# EasyEDA Pro project URADORRY-SUN1.2.eprj, board Main(1.2)
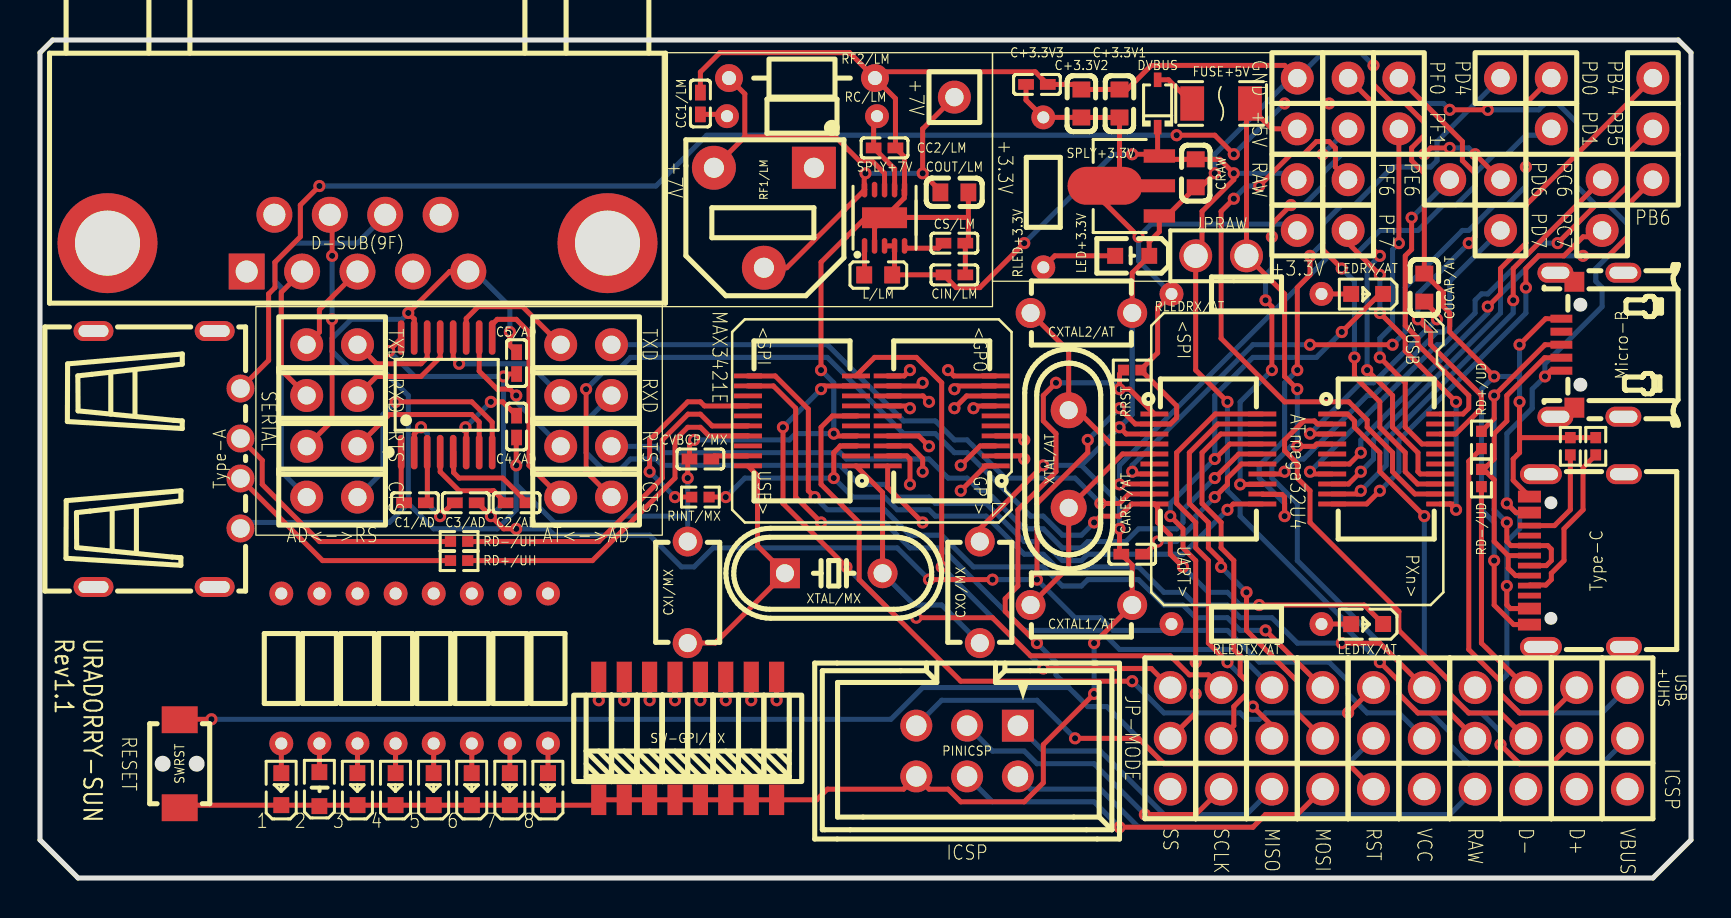
[diagram p11: board, top side]
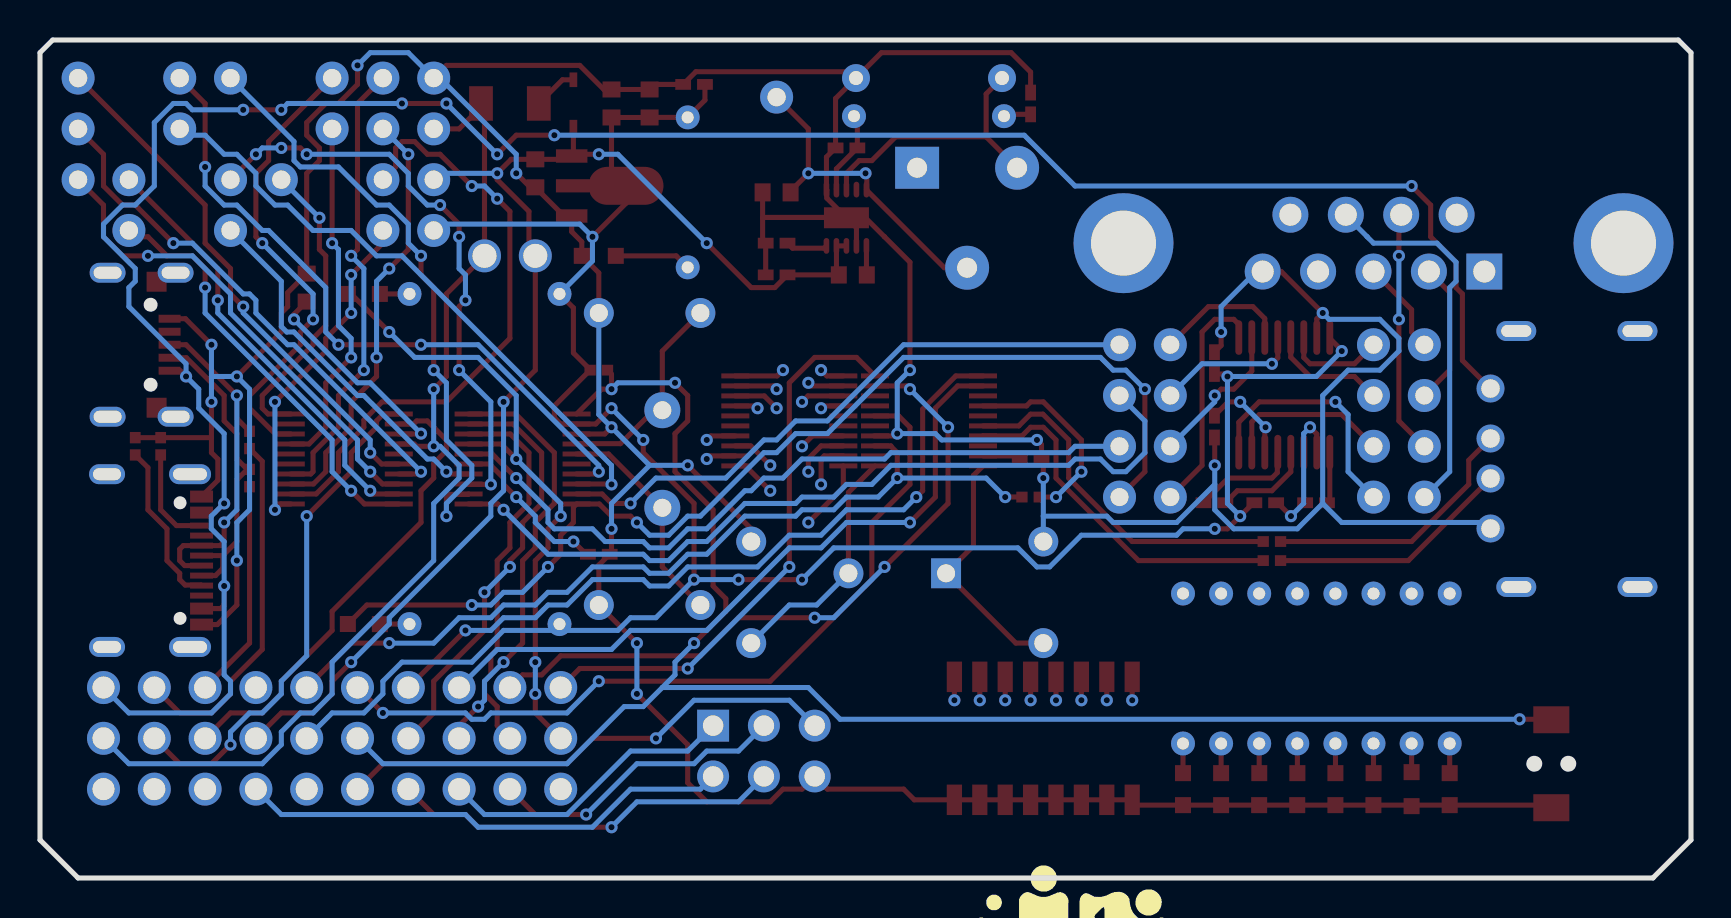
[diagram p12: board, bottom side, seen from below]

Outline 82.55 x 41.91 mm; copper layers: Top Layer, Inner1, Inner2, Bottom Layer. Coordinates in mm from the lower left corner of the outline.
Outline path: 0,41.28 0.64,41.91 81.91,41.91 82.55,41.28 82.55,1.91 80.65,0 1.91,0 0,1.91 0,41.28
Stack: Top Layer 0.035mm 外层铜厚1oz / Dielectric1 0.2104mm 7628 RC49% 8.6mil / Inner1 0.0152mm 内层铜厚 / Dielectric2 1.065mm 1.1mm H/HOZ 含铜 / Inner2 0.0152mm 内层铜厚 / Dielectric3 0.2104mm 7628 RC49% 8.6mil / Bottom Layer 0.035mm 外层铜厚1oz

## Design rules (mm)
template: JLCPCB Capability(Two Layers Board)
spacing copperThickness1oz (default): track to track 0.102, other pairs 0.152 to 0.3
spacing copperThickness2oz: track to track 0.203, other pairs 0.152 to 0.3
track width copperThickness1oz (default): min 0.127, default 0.254, max 2.54
track width copperThickness2oz: min 0.203, default 0.254, max 2.54
differential pair differentialPair (default): width min 0.127, default 0.254, max 2.54; gap min 0.152, default 0.152
via viaSize (default): diameter min 0.5, default 0.61, max 10; hole min 0.3, default 0.305, max 6.3

## Placement (name value [footprint] x y rotation side)
C1/AD  100nF  [C0402]  18.75 18.77 180 top
C2/AD  100nF  [C0402]  23.83 18.77 180 top
C3/AD  100nF  [C0402]  21.29 18.77 180 top
C4/AD  100nF  [C0402]  23.83 22.58 90 top
C5/AD  100nF  [C0402]  23.83 25.75 90 top
C+3.3V1  10uF  [C0603]  53.97 38.74 90 top
C+3.3V2  1uF  [C0603]  52.07 38.74 90 top
C+3.3V3  100nF  [C0402]  49.85 39.69 0 top
CAREF/AT  100nF  [C0402]  54.61 16.19 0 top
CC1/LM  2.2nF  [C0402]  33.02 38.74 90 top
CC2/LM  15pF  [C0402]  42.23 36.51 0 top
CIN/LM  4.7uF  [C0402]  45.72 30.16 0 top
COUT/LM  10uF  [C0603]  45.72 34.29 0 top
CRAW  10uF  [C0603]  57.78 35.24 270 top
CS/LM  10nF  [C0402]  45.72 31.75 180 top
CUCAP/AT  1uF  [C0603]  69.22 29.53 270 top
CVBCP/MX  100nF  [C0402]  33.02 20.96 0 top
CXI/MX  20pF  [CAP-TH_L5.0-W3.2-P5.08-D0.6]  32.39 14.29 270 top
CXO/MX  20pF  [CAP-TH_L5.0-W3.2-P5.08-D0.6]  46.99 14.29 270 top
CXTAL1/AT  20pF  [CAP-TH_L5.0-W3.2-P5.08-D0.6]  52.07 13.65 180 top
CXTAL2/AT  20pF  [CAP-TH_L5.0-W3.2-P5.08-D0.6]  52.07 28.26 180 top
D-SUB(9F)  D-SUB-DR-9PCM-CB  [DB9-TH_ID09S33E4GV00LF]  15.88 31.75 180 top
DVBUS  CUS08F30,H3F  [SOD-323F_L2.0-W1.6-LS2.5-RD]  55.88 38.74 90 top
FUSE+5V  BSMD1206-050-16V  [F1206]  59.06 38.74 180 top
JP+3.3V  PZ254V-11-03P  [hdr-th_3p-p2.54-v-m]  69.22 6.99 90 top
JP+5V  PZ254V-11-03P  [hdr-th_3p-p2.54-v-m]  79.38 6.99 90 top
JPCTS-AT  MF254V-11-02-0743  [hdr-th_2p-p2.54-v-f-2]  27.31 19.05 180 top
JPCTS-RS  MF254V-11-02-0743  [hdr-th_2p-p2.54-v-f-2]  14.61 19.05 180 top
JPD+  PZ254V-11-03P  [hdr-th_3p-p2.54-v-m]  76.84 6.99 90 top
JPD-  PZ254V-11-03P  [hdr-th_3p-p2.54-v-m]  74.3 6.99 90 top
JPMISO  PZ254V-11-03P  [hdr-th_3p-p2.54-v-m]  61.59 6.99 90 top
JPMOSI  PZ254V-11-03P  [hdr-th_3p-p2.54-v-m]  64.14 6.99 90 top
JPRAW  PZ254V-11-02P  [hdr-th_2p-p2.54-v-m]  59.06 31.12 180 top
JPRAW2  PZ254V-11-03P  [hdr-th_3p-p2.54-v-m]  71.75 6.99 90 top
JPRST  PZ254V-11-03P  [hdr-th_3p-p2.54-v-m]  66.68 6.99 90 top
JPRTS-AT  MF254V-11-02-0743  [hdr-th_2p-p2.54-v-f-2]  27.31 21.59 180 top
JPRTS-RS  MF254V-11-02-0743  [hdr-th_2p-p2.54-v-f-2]  14.61 21.59 180 top
JPRXD-AT  MF254V-11-02-0743  [hdr-th_2p-p2.54-v-f-2]  27.31 24.13 180 top
JPRXD-RS  MF254V-11-02-0743  [hdr-th_2p-p2.54-v-f-2]  14.61 24.13 180 top
JPSCLK  PZ254V-11-03P  [hdr-th_3p-p2.54-v-m]  59.06 6.99 90 top
JPSS  PZ254V-11-03P  [hdr-th_3p-p2.54-v-m]  56.52 6.99 90 top
JPTXD-AT  MF254V-11-02-0743  [hdr-th_2p-p2.54-v-f-2]  27.31 26.67 180 top
JPTXD-RS  MF254V-11-02-0743  [hdr-th_2p-p2.54-v-f-2]  14.61 26.67 180 top
L/LM  4.7uH  [L0603]  41.91 30.16 180 top
LED+3.3V  XL-TD1608SURC  [LED0603-R-RD_RED]  54.61 31.12 180 top
LEDGPO0  19-217UYOC/S3112/TR8  [LED0603-RD]  12.07 4.45 90 top
LEDGPO1  XL-1608UBC-06A  [LED0603-R-RD]  13.97 4.45 90 top
LEDGPO2  XL-1608PGC-06  [LED0603-RD_GREEN]  15.88 4.45 90 top
LEDGPO3  NCD0603C1  [LED0603-RD]  17.78 4.45 90 top
LEDGPO4  XL-1608UPC-06  [LED0603-RD_PINK]  19.69 4.45 90 top
LEDGPO5  XL-1608UVC-04  [LED0603-RD_PINK]  21.59 4.45 90 top
LEDGPO6  NCD0603A1  [LED0603-RD]  23.5 4.45 90 top
LEDGPO7  NCD0603W1  [LED0603-RD]  25.4 4.45 90 top
LEDRX/AT  NCD0603C1  [LED0603-RD]  66.36 29.21 180 top
LEDTX/AT  XL-1608PGC-06  [LED0603-RD_GREEN]  66.36 12.7 180 top
Micro-B  HX MICRO 4P DIP JB  [MINI-USB-SMD_HANXIA_HXMICRO4PDIPJB]  77.47 26.67 90 top
MTAPP(F)/AT  AXK5F20547YG  [CONN-SMD_AXK5F20547YG]  67.31 20.96 270 top
MTGPIO(F)/MX  AXK5F20547YG  [CONN-SMD_AXK5F20547YG]  45.09 22.86 90 top
MTSYS(F)/AT  AXK5F20547YG  [CONN-SMD_AXK5F20547YG]  58.42 20.96 270 top
MTSYS(F)/MX  AXK5F20547YG  [CONN-SMD_AXK5F20547YG]  38.1 22.86 90 top
PIN+3.3V  X5511FV-01-C30D97-0970  [hdr-th_1p-v-f-1]  62.87 32.39 0 top
PIN+5V  X5511FV-01-C30D97-0970  [hdr-th_1p-v-f-1]  62.87 37.47 0 top
PIN+7V  X5511FV-01-C30D97-0970  [hdr-th_1p-v-f-1]  45.72 39.05 0 top
PINGND  X5511FV-01-C30D97-0970  [hdr-th_1p-v-f-1]  62.87 40.01 0 top
PINICSP  FBH25401-D06S1001K6K  [IDC-TH_FBH25401-D06S1001K6K]  46.36 6.35 180 top
PINPB4  X5511FV-01-C30D97-0970  [hdr-th_1p-v-f-1]  80.65 40.01 0 top
PINPB5  X5511FV-01-C30D97-0970  [hdr-th_1p-v-f-1]  80.65 37.47 0 top
PINPB6  X5511FV-01-C30D97-0970  [hdr-th_1p-v-f-1]  80.65 34.93 0 top
PINPC6  X5511FV-01-C30D97-0970  [hdr-th_1p-v-f-1]  78.11 34.93 0 top
PINPC7  X5511FV-01-C30D97-0970  [hdr-th_1p-v-f-1]  78.11 32.39 0 top
PINPD0  X5511FV-01-C30D97-0970  [hdr-th_1p-v-f-1]  75.56 40.01 0 top
PINPD1  X5511FV-01-C30D97-0970  [hdr-th_1p-v-f-1]  75.56 37.47 0 top
PINPD4  X5511FV-01-C30D97-0970  [hdr-th_1p-v-f-1]  73.03 40.01 0 top
PINPD6  X5511FV-01-C30D97-0970  [hdr-th_1p-v-f-1]  73.03 34.93 0 top
PINPD7  X5511FV-01-C30D97-0970  [hdr-th_1p-v-f-1]  73.03 32.39 0 top
PINPE6  X5511FV-01-C30D97-0970  [hdr-th_1p-v-f-1]  70.49 34.93 0 top
PINPF0  X5511FV-01-C30D97-0970  [hdr-th_1p-v-f-1]  67.94 40.01 0 top
PINPF1  X5511FV-01-C30D97-0970  [hdr-th_1p-v-f-1]  67.94 37.47 0 top
PINPF4  X5511FV-01-C30D97-0970  [hdr-th_1p-v-f-1]  65.41 40.01 0 top
PINPF5  X5511FV-01-C30D97-0970  [hdr-th_1p-v-f-1]  65.41 37.47 0 top
PINPF6  X5511FV-01-C30D97-0970  [hdr-th_1p-v-f-1]  65.41 34.93 0 top
PINPF7  X5511FV-01-C30D97-0970  [hdr-th_1p-v-f-1]  65.41 32.39 0 top
PINRAW  X5511FV-01-C30D97-0970  [hdr-th_1p-v-f-1]  62.87 34.93 0 top
RC/LM  47kΩ  [RES-TH_BD1.7-L3.5-P7.50-D0.5]  38.1 38.1 180 top
RCC1/UD1  5.1kΩ  [R0402]  77.79 21.59 270 top
RCC2/UD1  5.1kΩ  [R0402]  76.52 21.59 270 top
RD+/UD  22Ω  [R0402]  72.07 21.91 90 top
RD+/UH  33Ω  [R0402]  20.96 15.88 180 top
RD-/UD  22Ω  [R0402]  72.07 20 90 top
RD-/UH  33Ω  [R0402]  20.96 16.83 180 top
RF1/LM  100kΩ  [RES-ADJ-SMD_RM065-V1]  36.19 33.02 180 top
RF2/LM  20kΩ  [RES-TH_BD1.9-L3.3-P7.30-D0.5]  38.1 40.01 0 top
RINT/MX  2.2kΩ  [R0402]  33.02 19.05 180 top
RLED+3.3V  300Ω  [RES-TH_BD1.7-L3.5-P7.50-D0.5]  50.16 34.29 270 top
RLEDGPO0  300Ω  [RES-TH_BD1.7-L3.5-P7.50-D0.5]  12.07 10.48 270 top
RLEDGPO1  100Ω  [RES-TH_BD1.7-L3.5-P7.50-D0.5]  13.97 10.48 270 top
RLEDGPO2  100Ω  [RES-TH_BD1.7-L3.5-P7.50-D0.5]  15.88 10.48 270 top
RLEDGPO3  300Ω  [RES-TH_BD1.7-L3.5-P7.50-D0.5]  17.78 10.48 270 top
RLEDGPO4  100Ω  [RES-TH_BD1.7-L3.5-P7.50-D0.5]  19.69 10.48 270 top
RLEDGPO5  300Ω  [RES-TH_BD1.7-L3.5-P7.50-D0.5]  21.59 10.48 270 top
RLEDGPO6  100Ω  [RES-TH_BD1.7-L3.5-P7.50-D0.5]  23.5 10.48 270 top
RLEDGPO7  100Ω  [RES-TH_BD1.7-L3.5-P7.50-D0.5]  25.4 10.48 270 top
RLEDRX/AT  300Ω  [RES-TH_BD1.7-L3.5-P7.50-D0.5]  60.33 29.21 0 top
RLEDTX/AT  100Ω  [RES-TH_BD1.7-L3.5-P7.50-D0.5]  60.33 12.7 0 top
RRST  10kΩ  [R0402]  54.61 25.4 180 top
SPLY+3.3V  AMS1117-3.3  [SOT-89-3L_L4.5-W2.5-P1.50-LS4.1-BR]  54.61 34.61 0 top
SPLY+7V  LM4510SD/NOPB  [VSON-10_L3.0-W3.0-P0.50-BL-EP-ADS8867IDRCR]  42.23 33.02 0 top
SW-GPI/MX  DHN-08-V-T/R  [SW-SMD_16P-L11.4-W4.5-P1.27-LS6.7]  32.39 6.99 0 top
SWRST  YTSA010A0201803B  [SW-SMD_L4.0-W3.0-LS5.0-EH]  6.98 5.72 90 top
Type-A  10.0 4C6.3 ZB  [USB-TH_10.0-4C6.3-ZB]  6.35 20.96 270 top
Type-C  TYPE-C16PIN  [USB-C-SMD_TYPE-C16PIN]  76.84 15.88 90 top
UARTtoRS232C  ADM3202ARUZ-REEL7  [TSSOP-16_L5.0-W4.4-P0.65-LS6.4-BL]  20.34 24.16 0 top
XTAL/AT  16MHz  [HC-49S_L11.0-W4.4-P4.88]  51.44 20.96 90 top
XTAL/MX  12MHz  [HC-49US_L11.5-W4.5-P4.88]  39.69 15.24 0 top

## Footprints (pads in the part's own frame, mm; a bottom-side part is the same pattern mirrored in y, then rotated)
C0402
  rect 0.79x0.54 smd: 1(-0.545,0) 2(0.545,0)
C0603
  rect 0.8x0.9 smd: 1(-0.7,0) 2(0.7,0)
CAP-TH_L5.0-W3.2-P5.08-D0.6
  round 1.5 hole 0.9: 1(-2.54,0) 2(2.54,0)
CONN-SMD_AXK5F20547YG
  rect 0.25x1.4 smd: 1(-2.25,-2.7) 2(-1.75,-2.7) 3(-1.25,-2.7) 4(-0.75,-2.7) 5(-0.25,-2.7) 6(0.25,-2.7) 7(0.75,-2.7) 8(1.25,-2.7) 9(1.75,-2.7) 10(2.25,-2.7) 11(2.25,2.7) 12(1.75,2.7) 13(1.25,2.7) 14(0.75,2.7) 15(0.25,2.7) 16(-0.25,2.7) 17(-0.75,2.7) 18(-1.25,2.7) 19(-1.75,2.7) 20(-2.25,2.7)
DB9-TH_ID09S33E4GV00LF
  rect 1.8x1.8 hole 1.1: 1(5.54,1.42)
  round 1.8 hole 1.1: 2(2.77,1.42) 3(0,1.42) 4(-2.77,1.42) 5(-5.54,1.42) 6(4.155,-1.42) 7(1.385,-1.42) 8(-1.385,-1.42) 9(-4.155,-1.42)
  round 5 hole 3.25: 10(-12.5,0) 11(12.5,0)
F1206
  rect 1.19x1.728 smd: 1(-1.445,0) 2(1.445,0)
HC-49S_L11.0-W4.4-P4.88
  round 1.8 hole 0.9: 1(-2.44,0) 2(2.44,0)
HC-49US_L11.5-W4.5-P4.88
  rect 1.5x1.5 hole 0.9: 1(-2.44,0)
  round 1.5 hole 0.9: 2(2.44,0)
hdr-th_1p-v-f-1
  round 1.651 hole 0.914x0.889: 1(0,0)
hdr-th_2p-p2.54-v-f-2
  round 1.651 hole 0.9x0.889: 1(-1.27,0) 2(1.27,0)
hdr-th_2p-p2.54-v-m
  round 1.651 hole 1.2x0.889: 1(-1.27,0) 2(1.27,0)
hdr-th_3p-p2.54-v-m
  round 1.651 hole 1.1x0.889: 1(-2.54,0) 2(0,0) 3(2.54,0)
IDC-TH_FBH25401-D06S1001K6K
  rect 1.6x1.6 hole 1.02: 1(-2.54,-1.27)
  round 1.6 hole 1.02: 2(-2.54,1.27) 3(0,-1.27) 4(0,1.27) 5(2.54,-1.27) 6(2.54,1.27)
L0603
  rect 0.8x0.864 smd: 1(-0.7,0) 2(0.7,0)
LED0603-R-RD
  rect 0.8x0.8 smd: 1(0.851,0) 2(-0.851,0)
LED0603-R-RD_RED
  rect 0.8x0.8 smd: 1(0.851,0) 2(-0.851,0)
LED0603-RD
  rect 0.8x0.8 smd: 1(-0.799,0) 2(0.799,0)
LED0603-RD_GREEN
  rect 0.8x0.8 smd: 1(-0.799,-0.004) 2(0.799,0.004)
LED0603-RD_PINK
  rect 0.8x0.8 smd: 1(-0.799,-0.004) 2(0.799,0.004)
MINI-USB-SMD_HANXIA_HXMICRO4PDIPJB
  rect 0.4x1.1 smd: 1(-1.3,1.4) 2(-0.65,1.4) 3(0,1.4) 4(0.65,1.4) 5(1.3,1.4)
  oval 1x1.8 hole 0.6x1.4: 6(3.6,1.7) 8(3.6,-1.7) 9(-3.6,-1.7) 11(-3.6,1.7)
  rect 1x1 smd: 7(3.15,0.75) 10(-3.15,0.75)
R0402
  rect 0.566x0.54 smd: 1(-0.433,0) 2(0.433,0)
RES-ADJ-SMD_RM065-V1
  rect 2.2x2.1 hole 1: 1(-2.5,-2.5)
  round 2.2 hole 1: 2(0,2.5) 3(2.5,-2.5)
RES-TH_BD1.7-L3.5-P7.50-D0.5
  round 1.2 hole 0.6: 1(-3.75,0) 2(3.75,0)
RES-TH_BD1.9-L3.3-P7.30-D0.5
  round 1.4 hole 0.7: 1(-3.65,0) 2(3.65,0)
SOD-323F_L2.0-W1.6-LS2.5-RD
  rect 0.73x0.385 smd: 1(-1.185,0) 2(1.185,0)
SOT-89-3L_L4.5-W2.5-P1.50-LS4.1-BR
  rect 1.575x0.672 smd: 1(1.356,-1.5) 3(1.356,1.5)
  custom 5.377x1.9 smd: 2(-1.356,0.009)
SW-SMD_16P-L11.4-W4.5-P1.27-LS6.7
  rect 0.762x1.524 smd: 1(-4.445,-3.075) 2(-3.175,-3.075) 3(-1.905,-3.075) 4(-0.635,-3.075) 5(0.635,-3.075) 6(1.905,-3.075) 7(3.175,-3.075) 8(4.445,-3.075) 9(4.445,3.075) 10(3.175,3.075) 11(1.905,3.075) 12(0.635,3.075) 13(-0.635,3.075) 14(-1.905,3.075) 15(-3.175,3.075) 16(-4.445,3.075)
SW-SMD_L4.0-W3.0-LS5.0-EH
  rect 1.35x1.8 smd: 1(-2.2,0) 2(2.2,0)
TSSOP-16_L5.0-W4.4-P0.65-LS6.4-BL
  oval 0.343x1.732 smd: 1(-2.275,-2.866) 2(-1.625,-2.866) 3(-0.975,-2.866) 4(-0.325,-2.866) 5(0.325,-2.866) 6(0.975,-2.866) 7(1.625,-2.866) 8(2.275,-2.866) 9(2.275,2.866) 10(1.625,2.866) 11(0.975,2.866) 12(0.325,2.866) 13(-0.325,2.866) 14(-0.975,2.866) 15(-1.625,2.866) 16(-2.275,2.866)
USB-C-SMD_TYPE-C16PIN
  oval 1x2.1 hole 0.6x1.7: 1(-4.32,1.788) 2(4.32,1.788)
  oval 1x1.8 hole 0.6x1.4: 3(-4.32,-2.362) 4(4.32,-2.362)
  rect 0.6x1.15 smd: A1B12(-3.2,2.362) A4B9(-2.4,2.362) B1A12(3.2,2.362) B4A9(2.4,2.362)
  rect 0.3x1.15 smd: A5(-1.25,2.362) A6(-0.25,2.362) A7(0.25,2.362) A8(-1.75,2.362) B5(1.75,2.362) B6(0.75,2.362) B7(-0.75,2.362) B8(1.25,2.362)
USB-TH_10.0-4C6.3-ZB
  round 1.4 hole 0.92: 1(-3.525,3.675) 2(-1.025,3.675) 3(0.975,3.675) 4(3.475,3.675)
  oval 1x2 hole 0.6x1.5: 5(-6.4,-3.675) 6(-6.4,2.386) 7(6.4,-3.675) 8(6.4,2.386)
VSON-10_L3.0-W3.0-P0.50-BL-EP-ADS8867IDRCR
  oval 0.28x0.787 smd: 1(-1,-1.407) 2(-0.5,-1.407) 3(0,-1.407) 4(0.5,-1.407) 5(1,-1.407) 6(1,1.407) 7(0.5,1.407) 8(0,1.407) 9(-0.5,1.407) 10(-1,1.407)
  rect 2.25x1.05 smd: 11(0,0)

## Nets
As in the schematic.

Pads without a net: D-SUB(9F) 1 4 6 9 10 11; JP+3.3V 1; JP+5V 1; JPD+ 1; JPD- 1; JPRAW2 3; JPSS 1; Micro-B 4 6 7 8 9 10 11; MTAPP(F)/AT 5 15 16 19; MTGPIO(F)/MX 5 6 15 16; MTSYS(F)/AT 6; MTSYS(F)/MX 2 5 7 8 13 15 18; RF1/LM 1; SPLY+7V 9; Type-A 5 6 7 8; Type-C 1 2 3 4 A8 B8

## Via types
v1: diameter 0.61, hole 0.305, Top Layer to Bottom Layer, 170 vias

## Routing (per net, layer and track width the routed paths; a pad name or vN(x,y) marks a point on that pad's centre or on a via; arc(x,y) is an arc through that point)
+3.3V: length 114.6
  Top Layer w0.254: v1(54.93,32.07) 53.25,33.74 SPLY+3.3V.2 53.97,35.34 C+3.3V1.1 C+3.3V2.1 52.06,38.04 RLED+3.3V.1 49.3,38.9 C+3.3V3.1 ; RLEDRX/AT.1 55.88,28.52 55.88,26.26 55.04,25.43 ; v1(23.18,25.08) 23.3,25.21 C5/AD.1 ; 55.04,25.43 RRST.1 56.83,23.61 56.83,23.02 56.52,22.71 54.77,22.71 v1(53.97,23.5) ; 55.04,25.43 55.04,25.43 ; UARTtoRS232C.16 18.06,26.99 17.46,26.39 v1(17.46,26.35) ; v1(52.39,21.91) 52.39,21.27 49.85,18.73 v1(49.85,14.92) ; v1(23.81,17.46) 23.18,17.46 v1(22.54,18.1) 21.87,18.77 C3/AD.1 ; v1(47.62,14.92) v1(44.45,14.92)
  Bottom Layer w0.254: v1(44.45,14.92) 42.86,16.51 33.66,16.51 32.7,15.56 32.07,15.56 30.48,17.15 25.72,17.15 25.4,17.46 v1(23.81,17.46) ; v1(17.46,26.35) 18.73,25.08 v1(23.18,25.08) 23.18,18.73 v1(22.54,18.1) ; RLEDRX/AT.1 54.93,30.86 v1(54.93,32.07) 55.56,32.7 62.55,32.7 PIN+3.3V.1 ; JP+3.3V.2 67.94,8.26 66.36,8.26 65.41,9.21 65.41,9.84 64.45,10.8 60.96,10.8 59.37,12.38 56.89,12.38 RLEDTX/AT.1 56.26,12.38 53.66,12.38 53.02,13.02 51.75,13.02 v1(49.85,14.92) v1(47.62,14.92) ; v1(53.97,23.5) v1(52.39,21.91)
+5V: length 52.3
  Top Layer w0.254: v1(62.87,24.45) 62.23,25.08 62.23,29.21 JPRAW.1 60.33,38.24 60.57,38.49 ; v1(62.87,21.59) 63.72,21.59 63.83,21.71 MTAPP(F)/AT.4 ; 60.57,38.49 60.57,38.66 FUSE+5V.1 ; 60.57,38.49 61.59,37.47 PIN+5V.1
  Bottom Layer w0.254: JP+5V.2 78.11,5.72 71.44,5.72 70.49,6.67 70.49,7.3 69.53,8.26 68.9,8.26 67.94,9.21 67.94,10.8 62.87,15.88 62.87,18.73 61.59,20 61.59,20.64 62.55,21.59 v1(62.87,21.59) v1(62.87,24.45)
+7V: length 16.2
  Top Layer w0.254: COUT/LM.1 45.02,34.36 v1(44.13,35.24) 44.13,37.47 PIN+7V.1 ; RF1/LM.2 37.34,30.52 41.23,34.41 SPLY+7V.10 41.21,34.44 41.21,35.18 v1(41.28,35.24)
  Bottom Layer w0.254: v1(41.28,35.24) v1(44.13,35.24)
GND: length 281.6
  Top Layer w0.254: v1(50.16,20.64) 46.99,17.46 CXO/MX.1 ; SPLY+7V.11 41.28,33.02 40.33,32.07 40.32,32.07 39.05,30.8 v1(39.05,25.4) ; SPLY+7V.11 42.24,33.04 ; SPLY+7V.11 41.73,32.52 SPLY+7V.2 ; 54.61,28.26 54.61,30.26 LED+3.3V.2 55.46,31.82 55.97,32.32 SPLY+3.3V.1 56.35,33.11 CRAW.2 58.04,34.54 v1(58.74,35.24) ; PINGND.1 62.23,40.64 55.56,40.64 54.36,39.44 C+3.3V1.2 C+3.3V2.2 52,39.44 51.75,39.69 C+3.3V3.2 49.76,40.32 42.07,40.32 RF2/LM.2 ; 23.81,21.91 v1(23.81,20.64) ; RF2/LM.2 40.48,41.28 33.99,41.28 33.02,40.3 CC1/LM.2 ; RF2/LM.2 42.77,38.98 CC2/LM.2 43.23,36.06 SPLY+7V.6 43.21,34.41 43.21,34 42.24,33.04 ; v1(53.97,22.54) 54.31,22.21 55.72,22.21 ; CIN/LM.2 CS/LM.1 46.42,31.91 46.42,33.02 ; 73.98,22.02 76.5,22.02 76.51,22.03 RCC2/UD1.1 RCC1/UD1.1 ; 73.98,22.02 v1(73.98,23.81) ; 73.98,22.02 73.98,21.27 73.66,20.96 73.66,19.89 Type-C.B1A12 ; SWRST.1 7.12,3.65 LEDGPO0.1 13.92,3.65 LEDGPO1.2 14.02,3.65 LEDGPO2.1 LEDGPO3.1 LEDGPO4.1 LEDGPO5.1 LEDGPO6.1 LEDGPO7.1 27.68,3.65 27.94,3.91 SW-GPI/MX.2 SW-GPI/MX.3 SW-GPI/MX.4 SW-GPI/MX.5 SW-GPI/MX.6 SW-GPI/MX.8 38.84,3.91 39.37,4.45 43.18,4.45 PINICSP.6 44.45,4.45 45.4,4.45 46.04,3.81 49.21,3.81 50.16,4.76 50.16,6.67 v1(52.71,9.21) ; v1(72.71,25.08) 70.49,27.31 70.49,28.26 70.17,28.58 70.17,29.28 CUCAP/AT.1 69.22,35.24 68.58,35.88 68.58,36.51 69.22,37.15 69.22,37.78 68.26,38.74 67.63,38.74 66.68,39.69 v1(66.68,40.64) ; Type-C.A1B12 73.69,12.68 72.71,13.65 v1(72.71,15.88) ; UARTtoRS232C.15 18.71,27.96 v1(18.42,28.26) 20.49,30.33 D-SUB(9F).5 ; v1(53.97,17.46) 53.97,16.28 CAREF/AT.1 54.61,15.65 54.61,13.65 v1(52.71,11.75) ; 42.24,33.04 46.4,33.04 46.42,33.02 ; 46.42,33.02 COUT/LM.2 ; 40.85,22.11 39.8,22.11 v1(39.69,22.23) ; v1(73.98,26.67) 75.28,27.97 Micro-B.5 ; v1(23.5,27.31) 23.5,26.63 C5/AD.2 ; v1(32.7,21.91) 32.48,21.68 CVBCP/MX.1 32.39,20.87 v1(32.39,20)
  Bottom Layer w0.254: 52.07,20.64 v1(53.97,22.54) 54.61,23.18 54.61,28.26 ; 52.07,20.64 53.97,18.73 v1(53.97,17.46) ; 52.07,20.64 v1(50.16,20.64) ; D-SUB(9F).5 21.74,30.33 23.5,28.58 v1(23.5,27.31) ; 73.98,25.08 v1(72.71,25.08) 72.07,24.45 72.07,18.42 72.71,17.78 v1(72.71,15.88) ; 73.98,25.08 v1(73.98,26.67) ; 73.98,25.08 v1(73.98,23.81) ; v1(32.7,21.91) 37.47,21.91 37.78,22.23 v1(39.69,22.23) 39.69,24.77 v1(39.05,25.4) ; 23.81,19.69 25.72,17.78 28.89,17.78 29.21,18.1 32.39,18.1 ; 23.81,19.69 23.81,18.42 22.86,17.46 19.69,17.46 18.42,18.73 ; 23.81,19.69 v1(23.81,20.64) ; v1(18.42,28.26) 18.1,27.94 15.56,27.94 14.61,26.99 14.61,26.35 15.56,25.4 17.15,25.4 18.42,24.13 18.42,18.73 ; CXI/MX.1 32.39,18.1 ; 32.39,18.1 v1(32.39,20) ; v1(52.71,9.21) v1(52.71,11.75) ; v1(58.74,35.24) 58.74,36.2 62.55,40.01 PINGND.1 64.14,41.28 66.04,41.28 v1(66.68,40.64) ; 18.42,18.73 17.46,17.78 10.33,17.78 Type-A.4